# EasyEDA Pro project 立创天空星STM32F407主板.eprj, schematic Schematic1

## Sheets
1 核心+音频输出: Board Name: Board1; Create Date: 2025-06-15; Page Name: 核心+音频输出; Project Name: 立创天空星STM32F407主板; Schematic Name: Schematic1; Update Date: 2025-07-28; Company: 嘉立创EDA; Page Size: A3; Version: V1.0
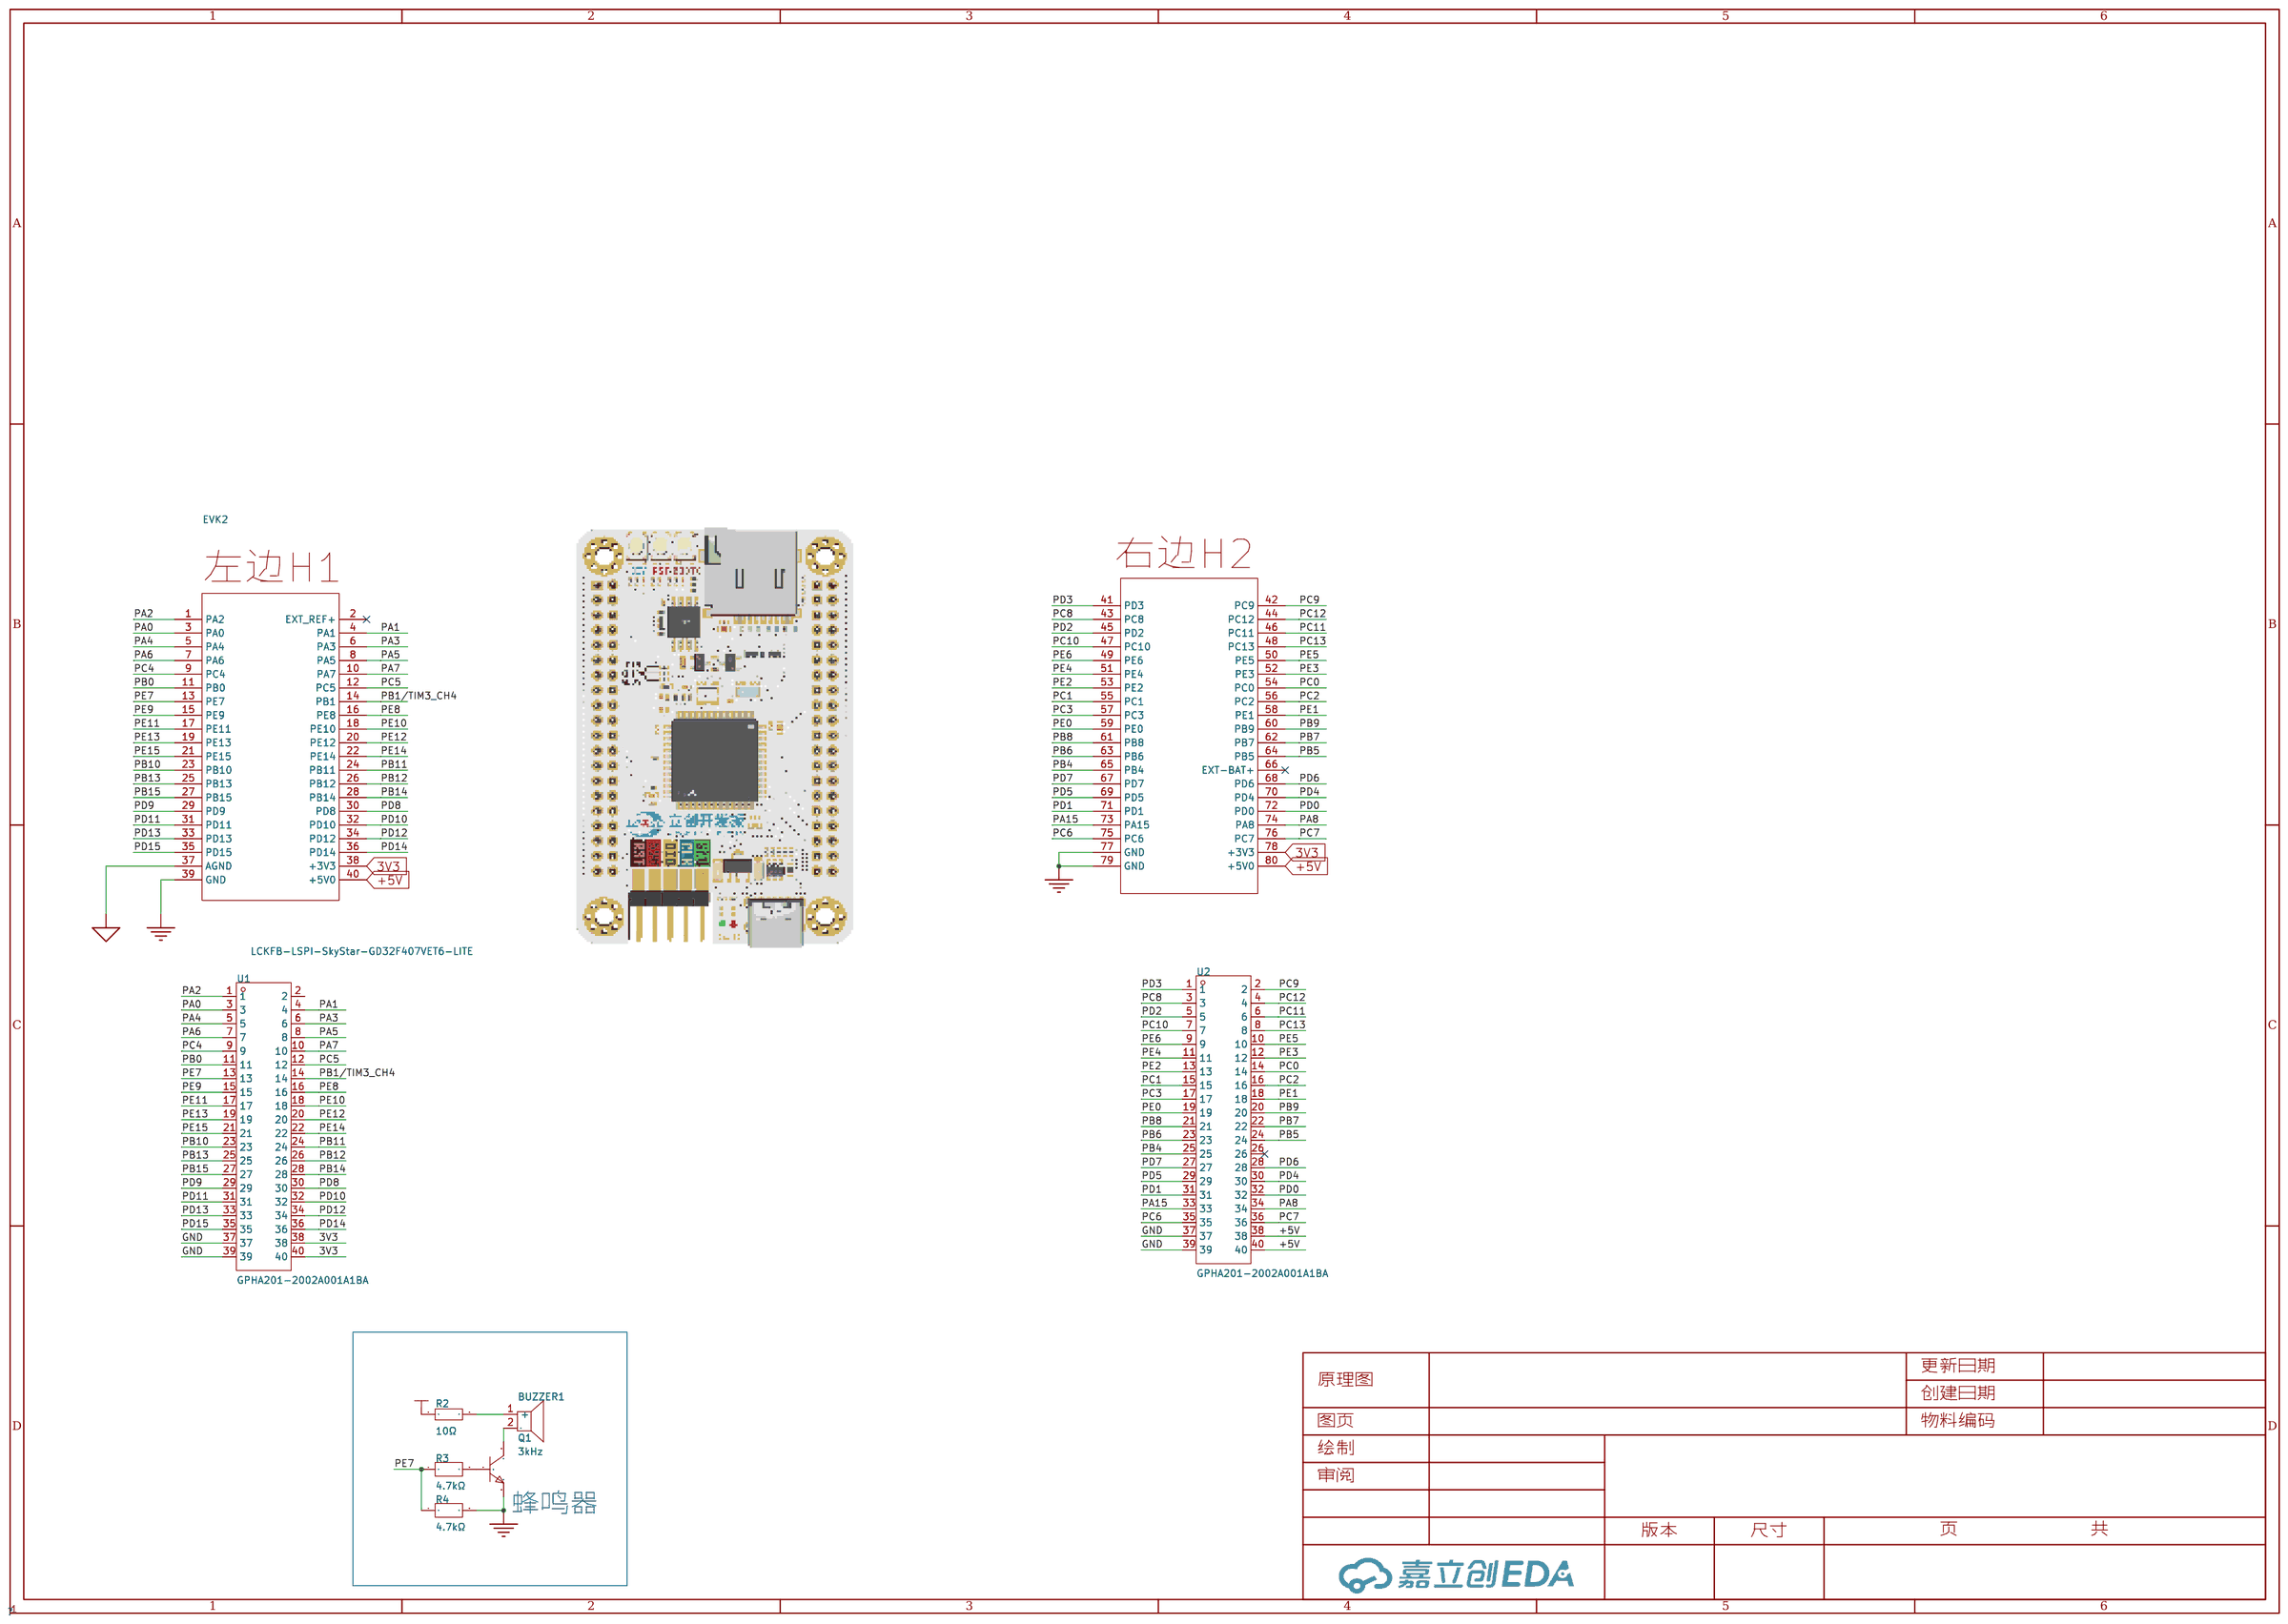
[diagram p0: 核心+音频输出]
2 用户模块: Page Name: 用户模块; Update Date: 2025-07-29; Page Size: A4
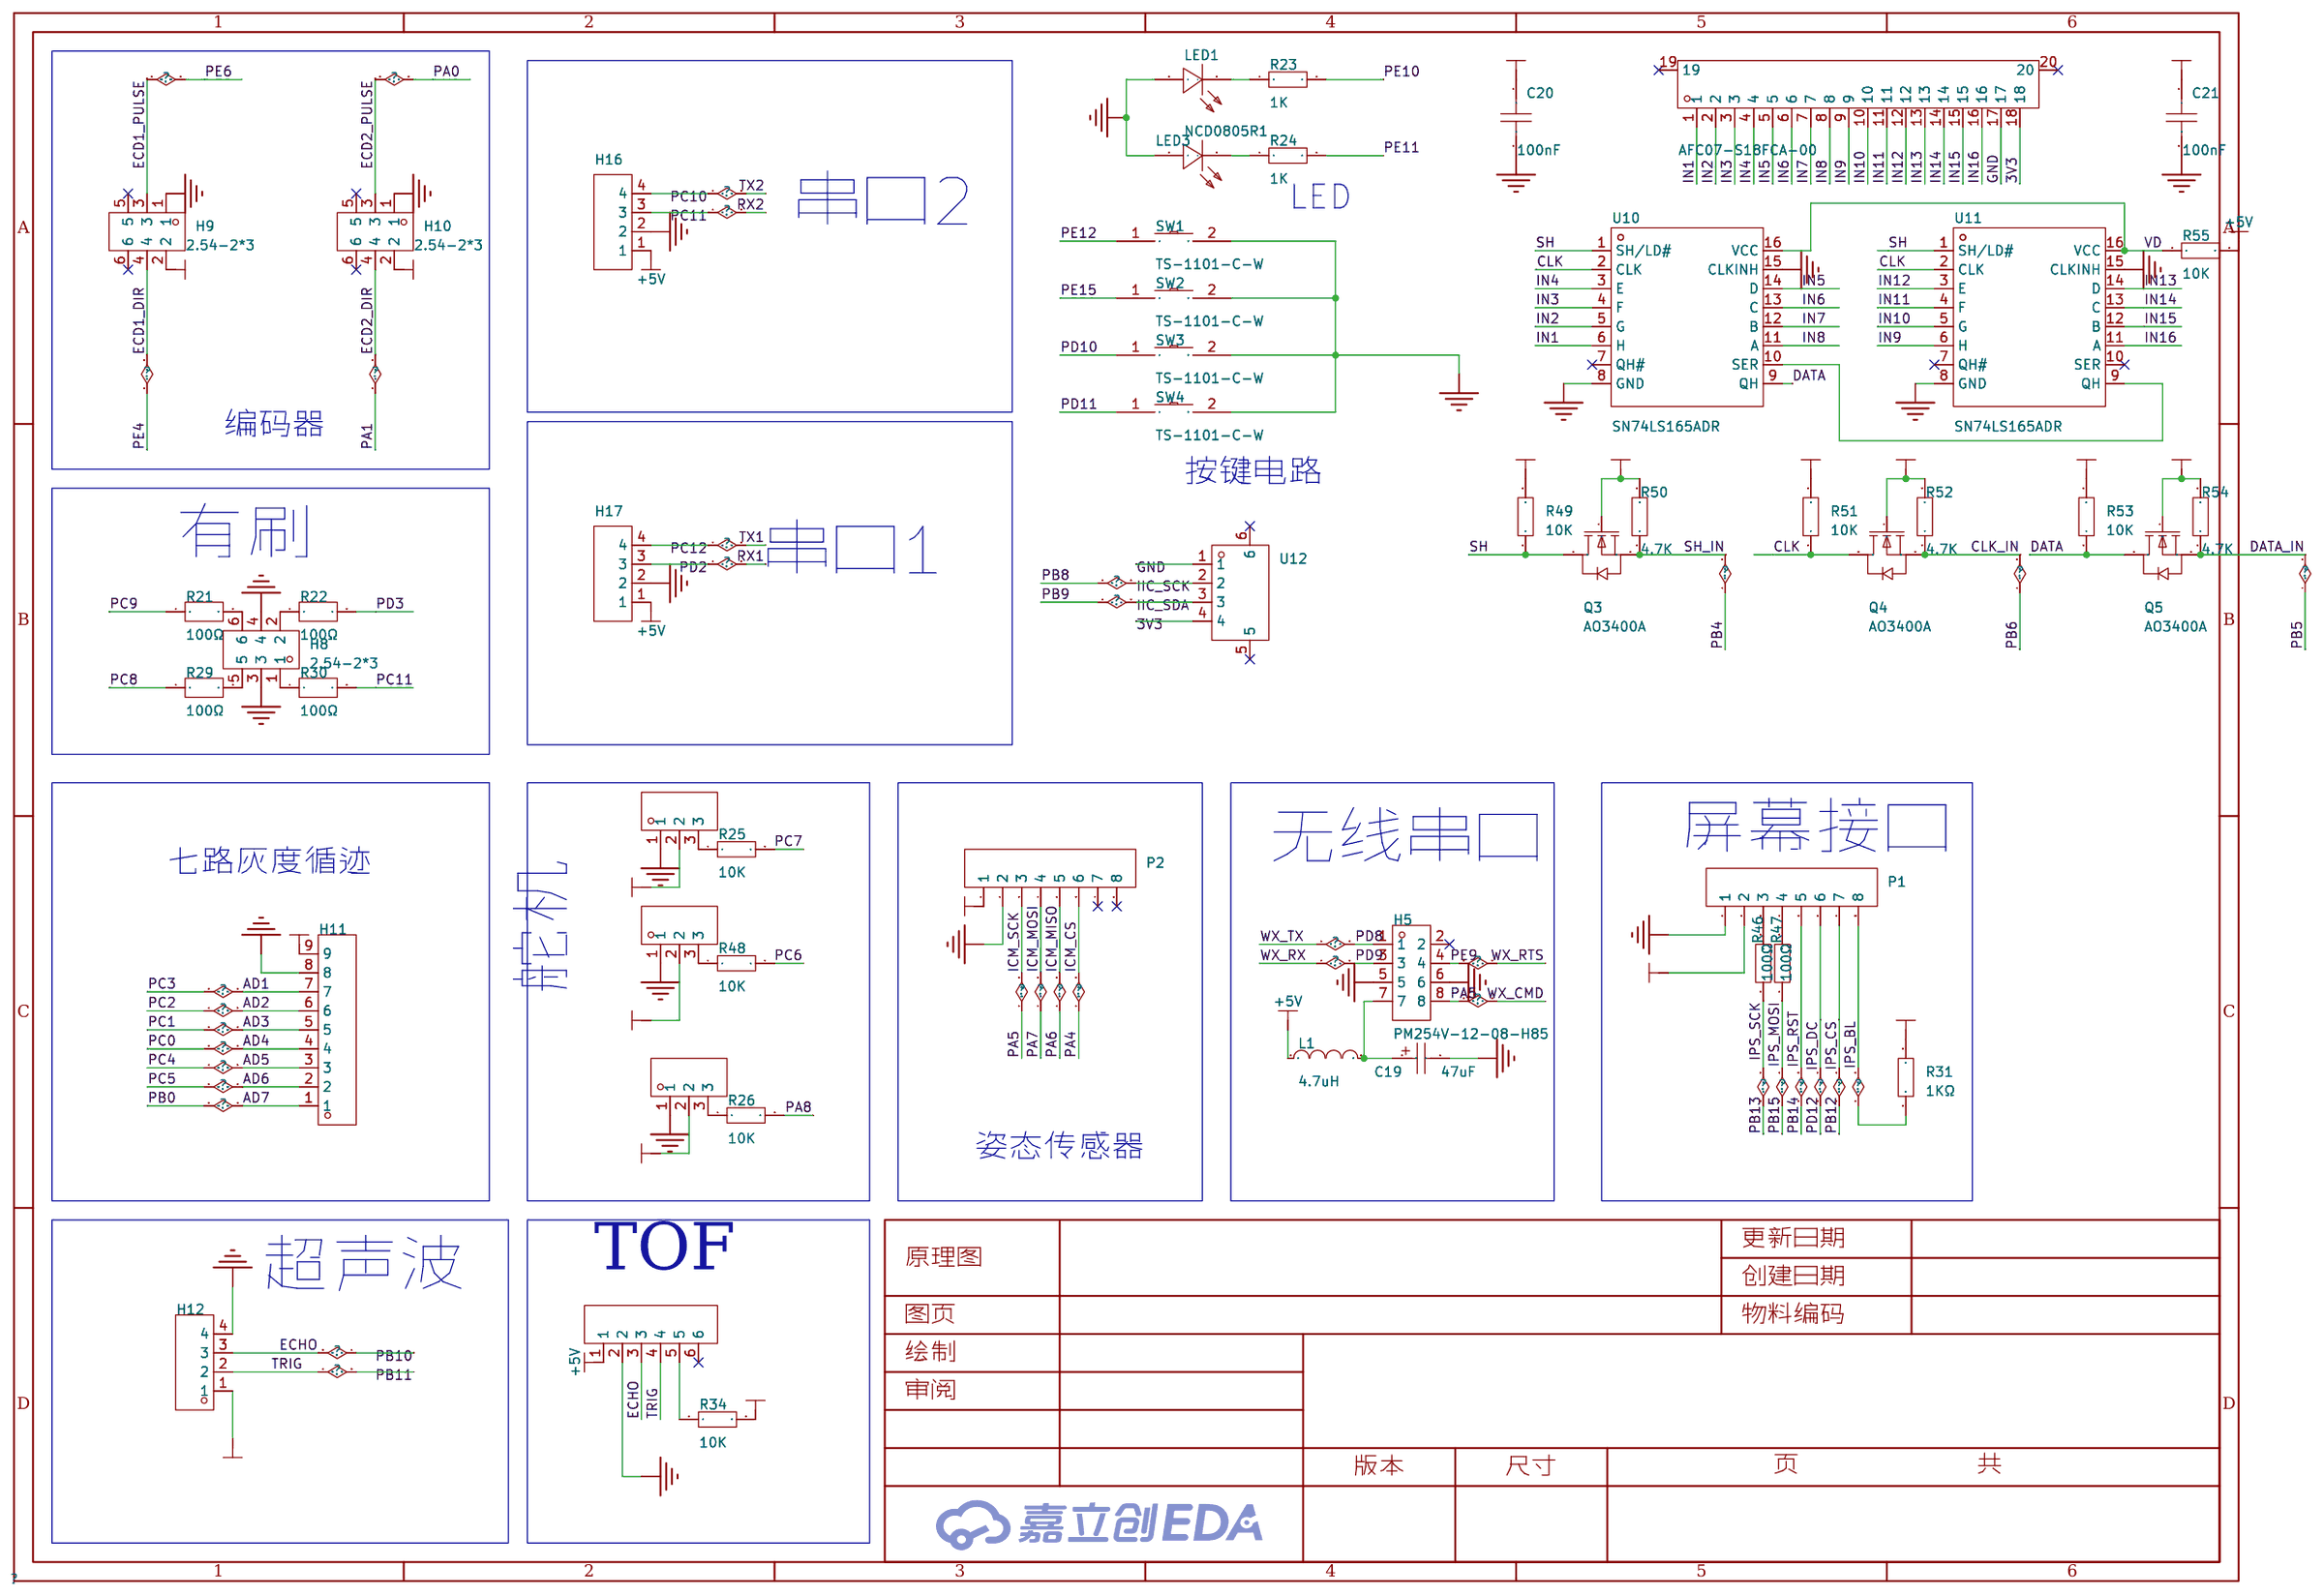
[diagram p1: 用户模块]
3 扩展模块: Page Name: 扩展模块
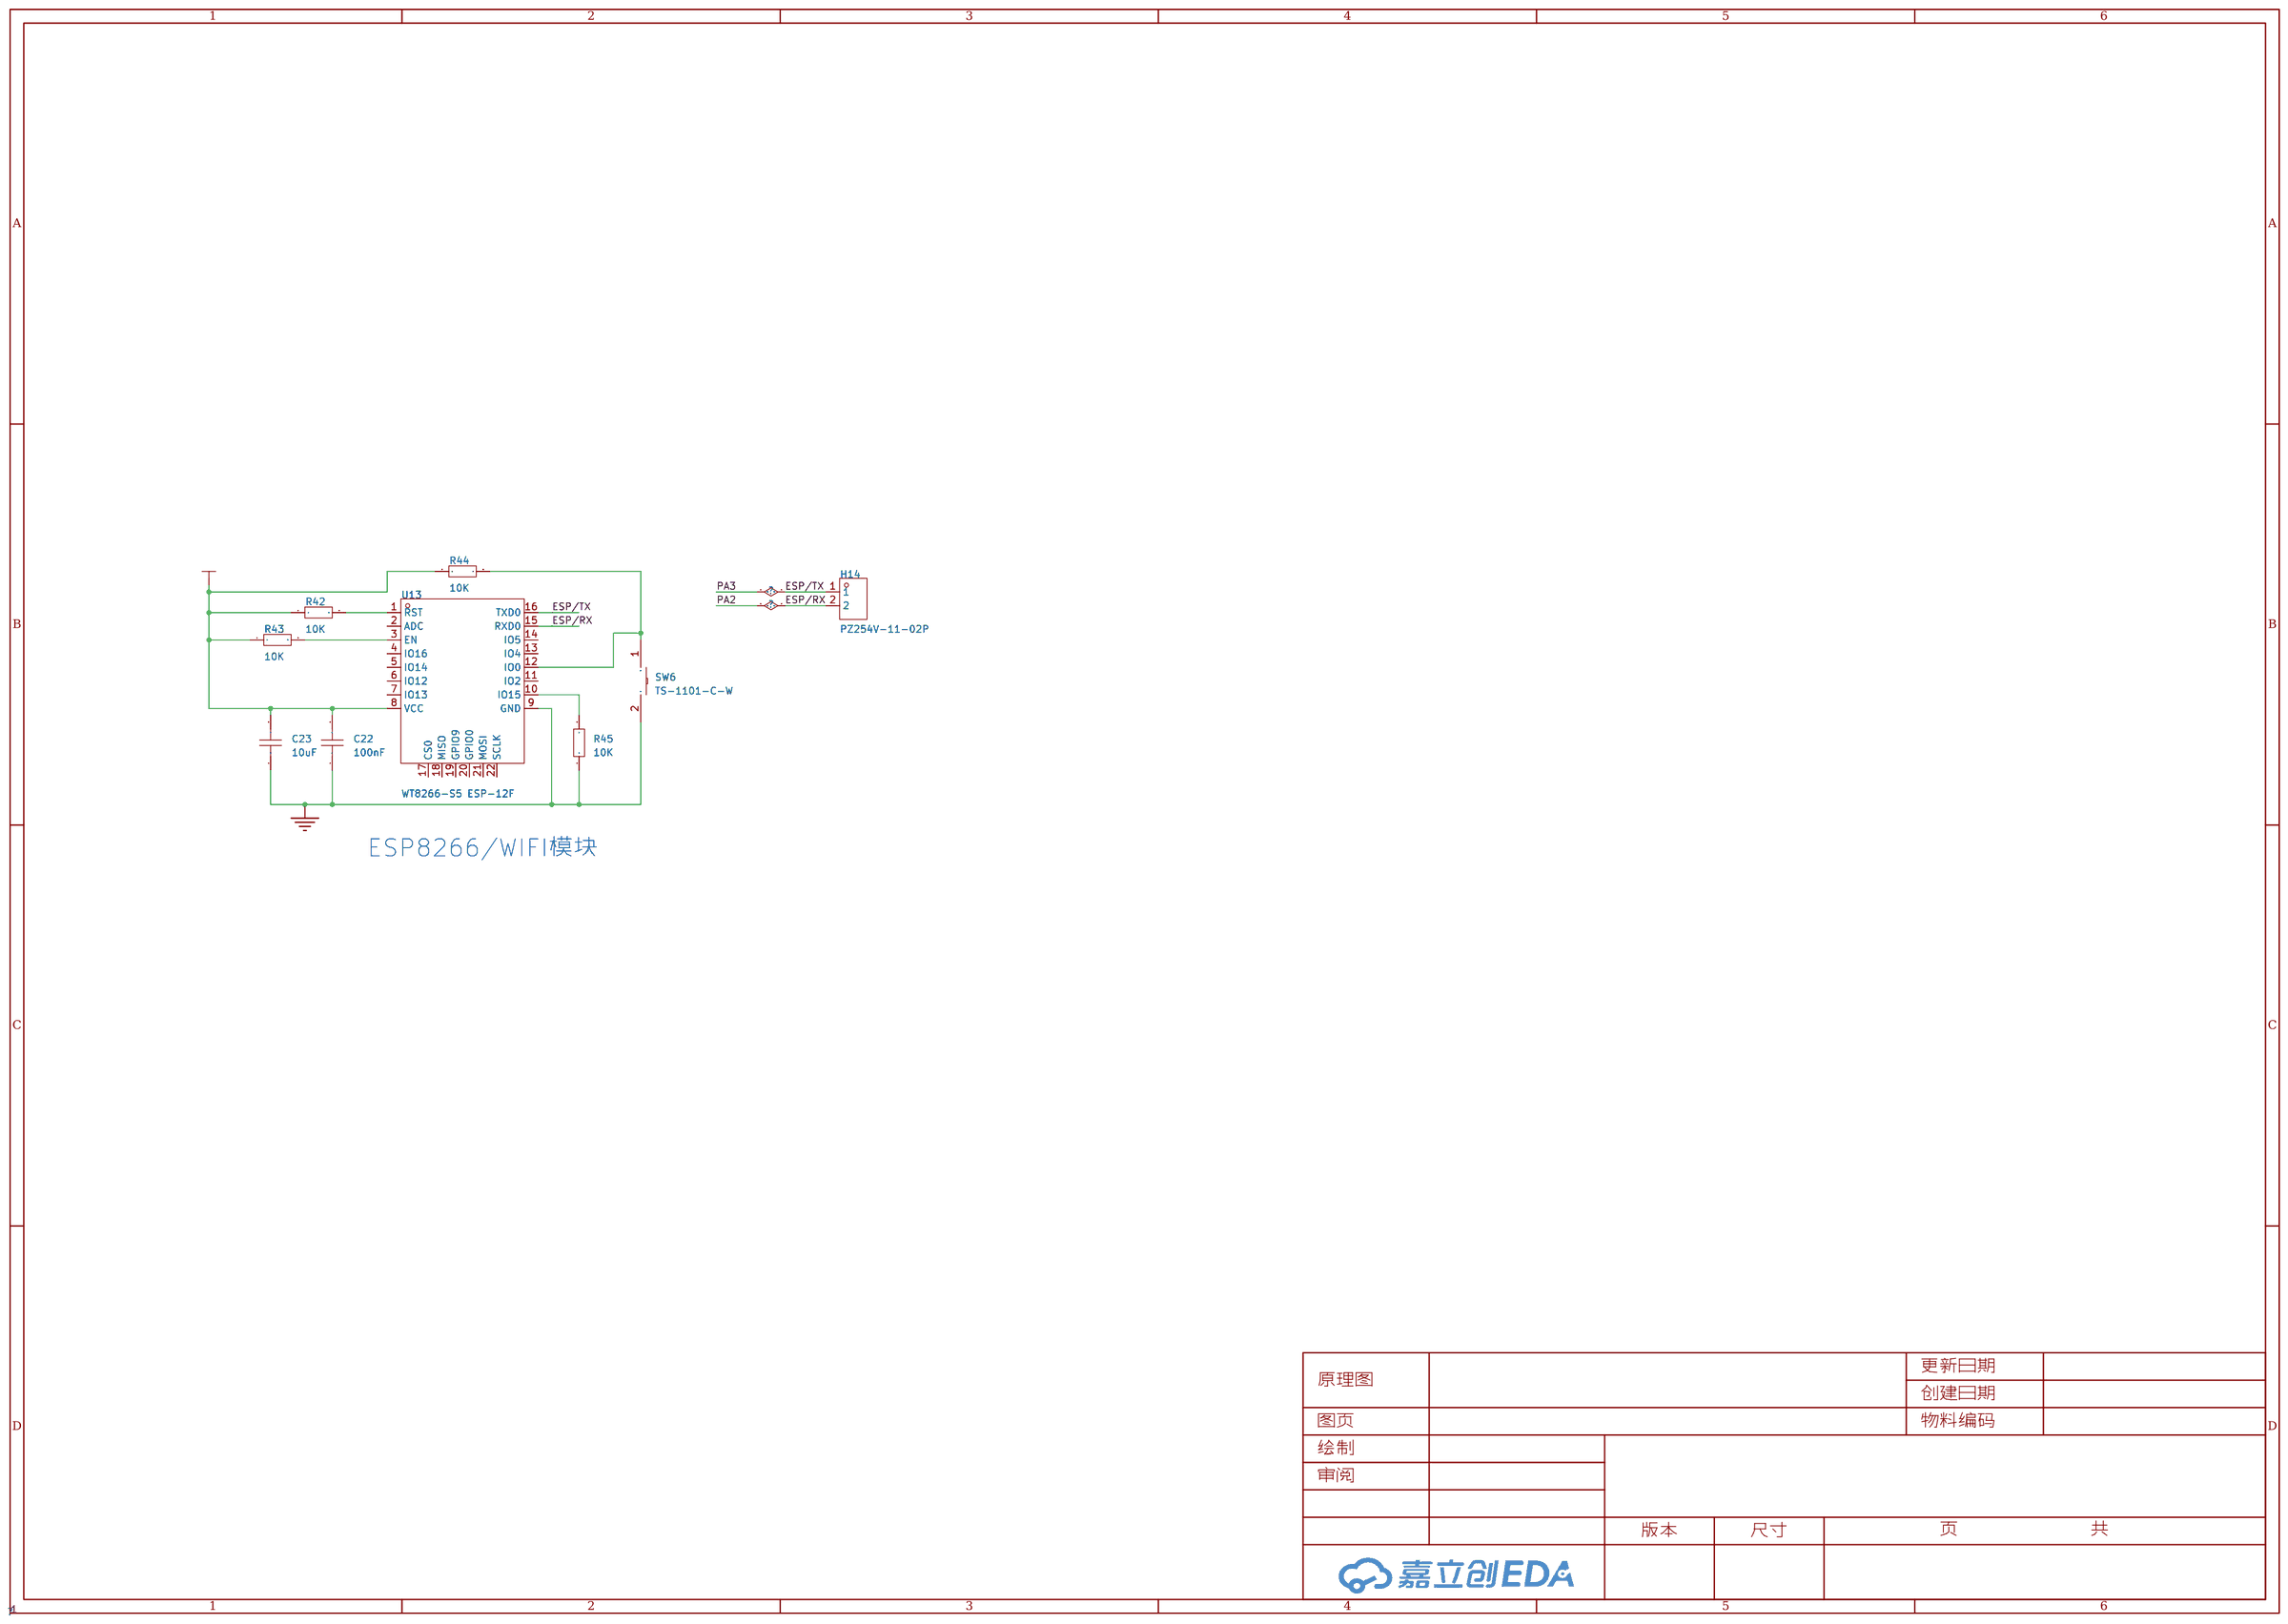
[diagram p2: 扩展模块]
4 电源: Create Date: 2025-07-28; Page Name: 电源; Page Size: A4
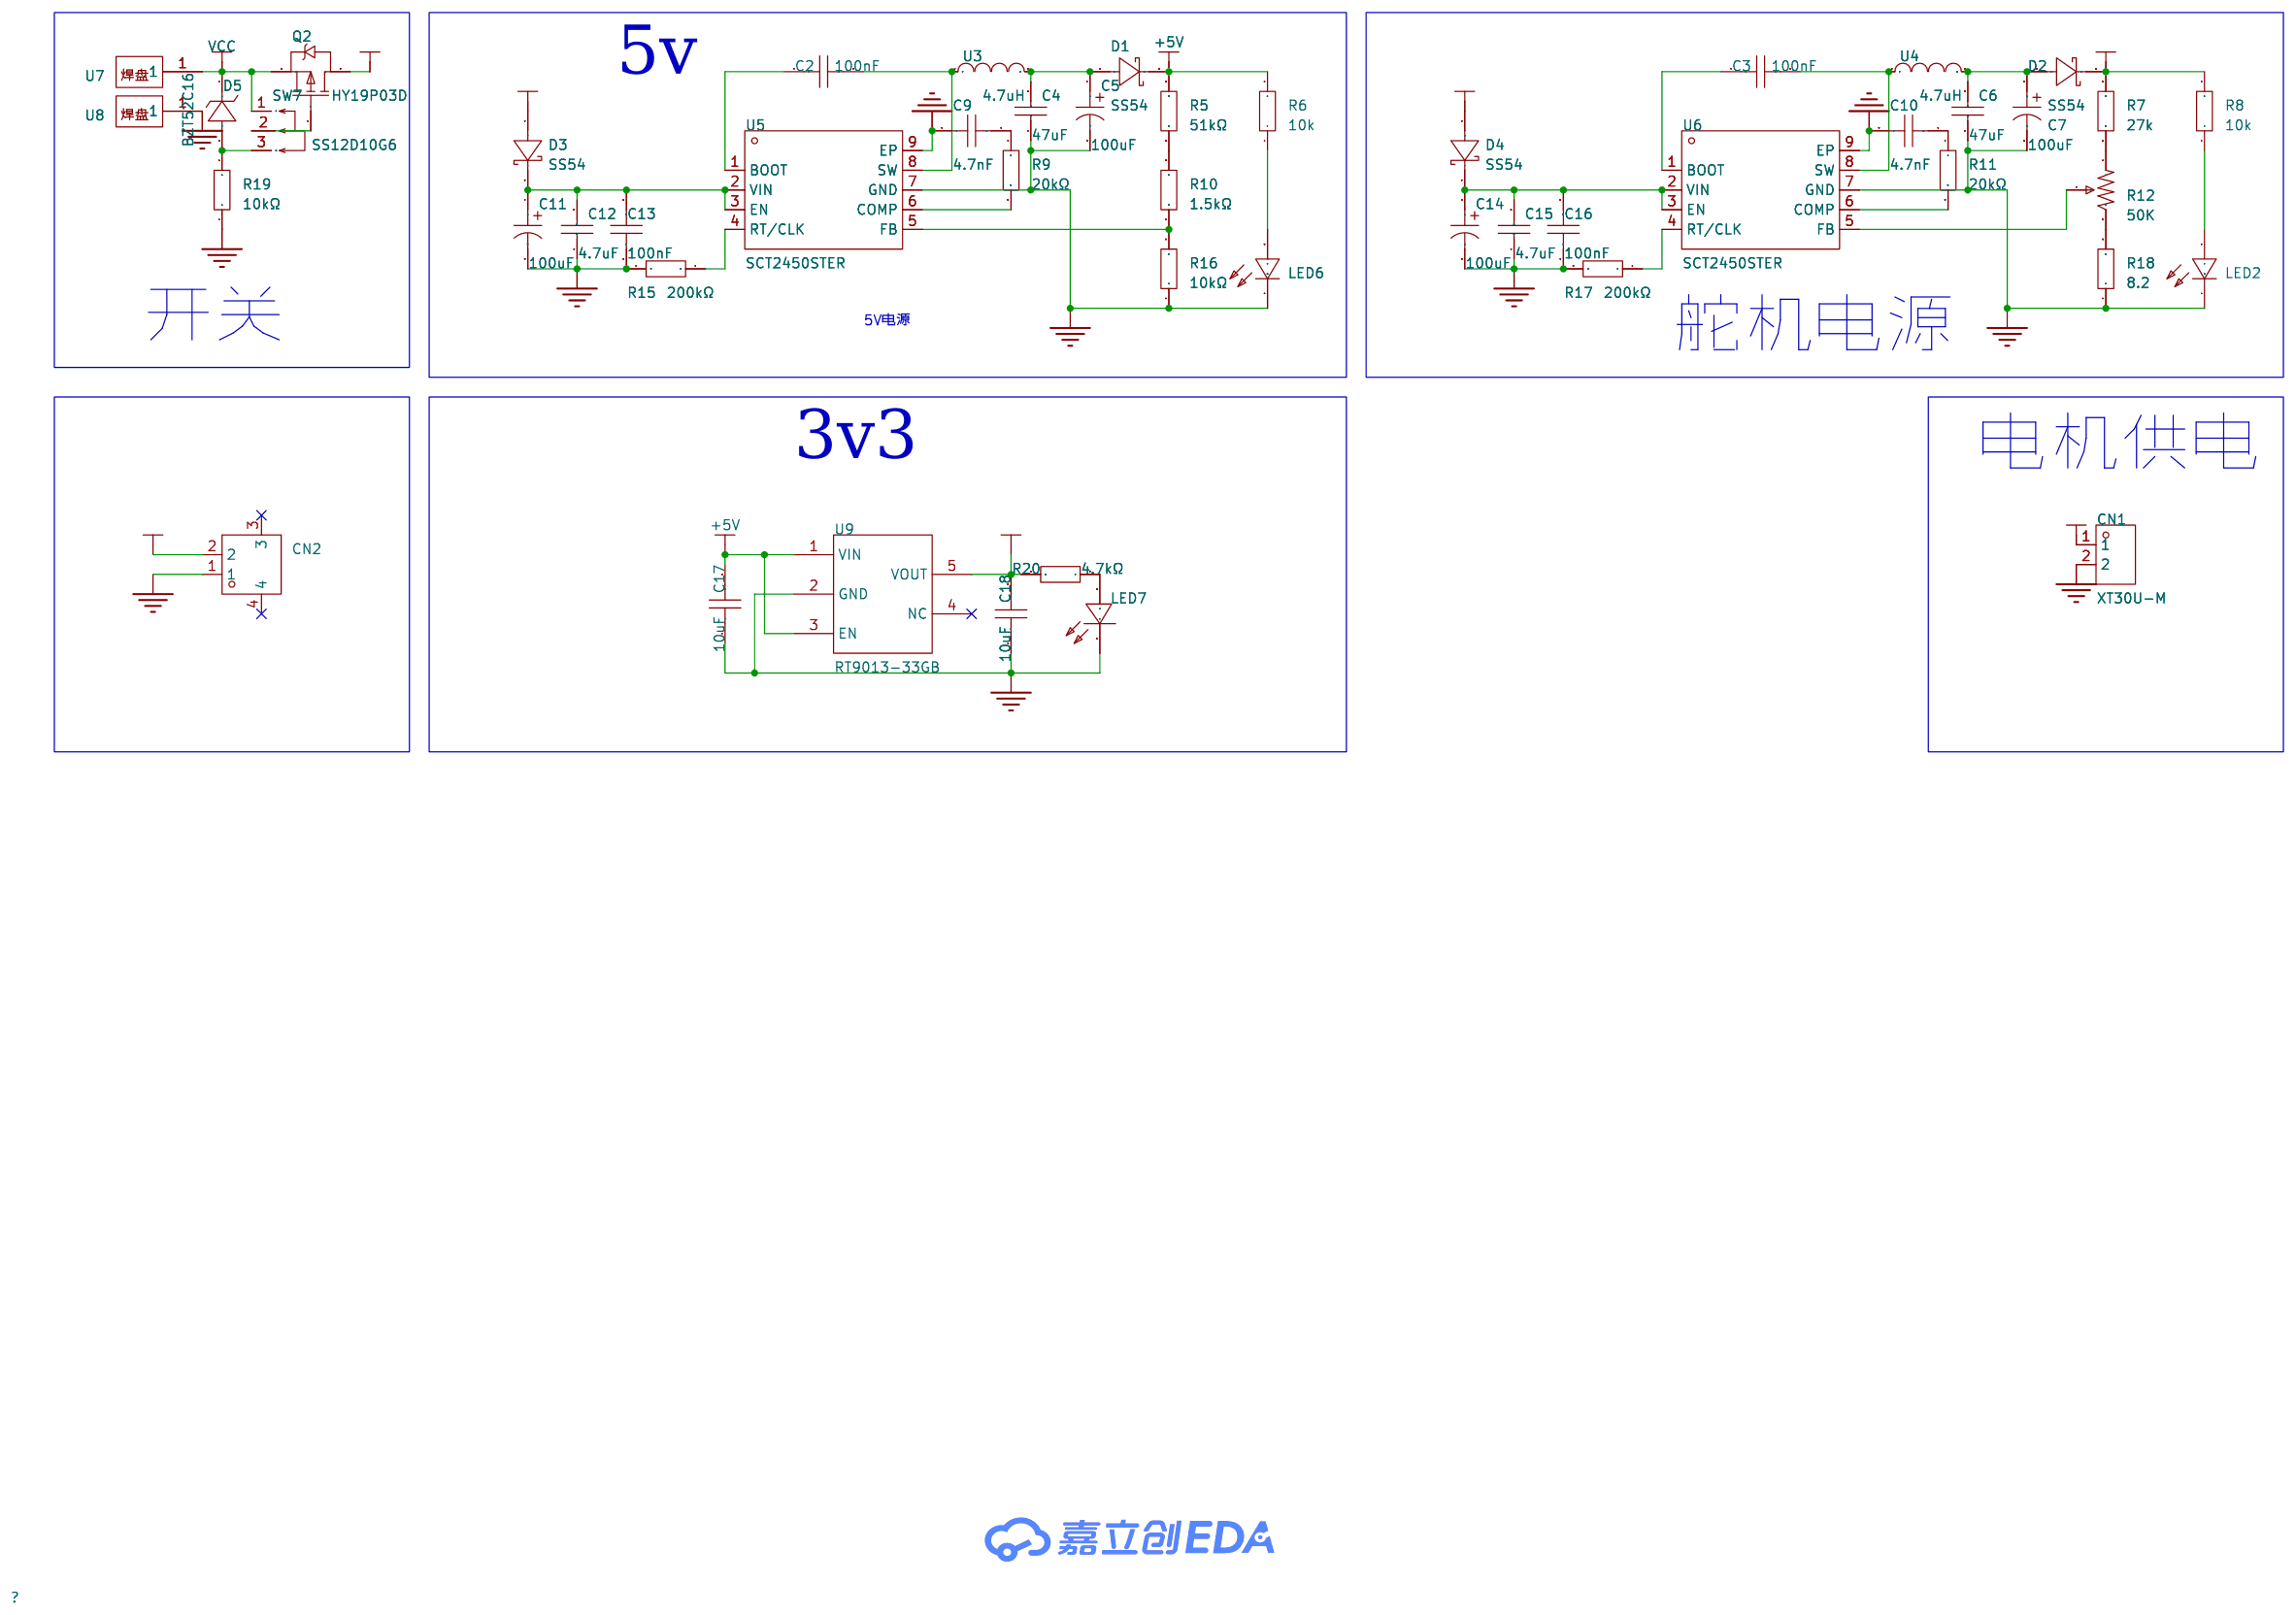
[diagram p3: 电源]
